# EasyEDA Pro project Access Control Core.eprj, schematic Card Reader (continued)
## Sheets (continued)
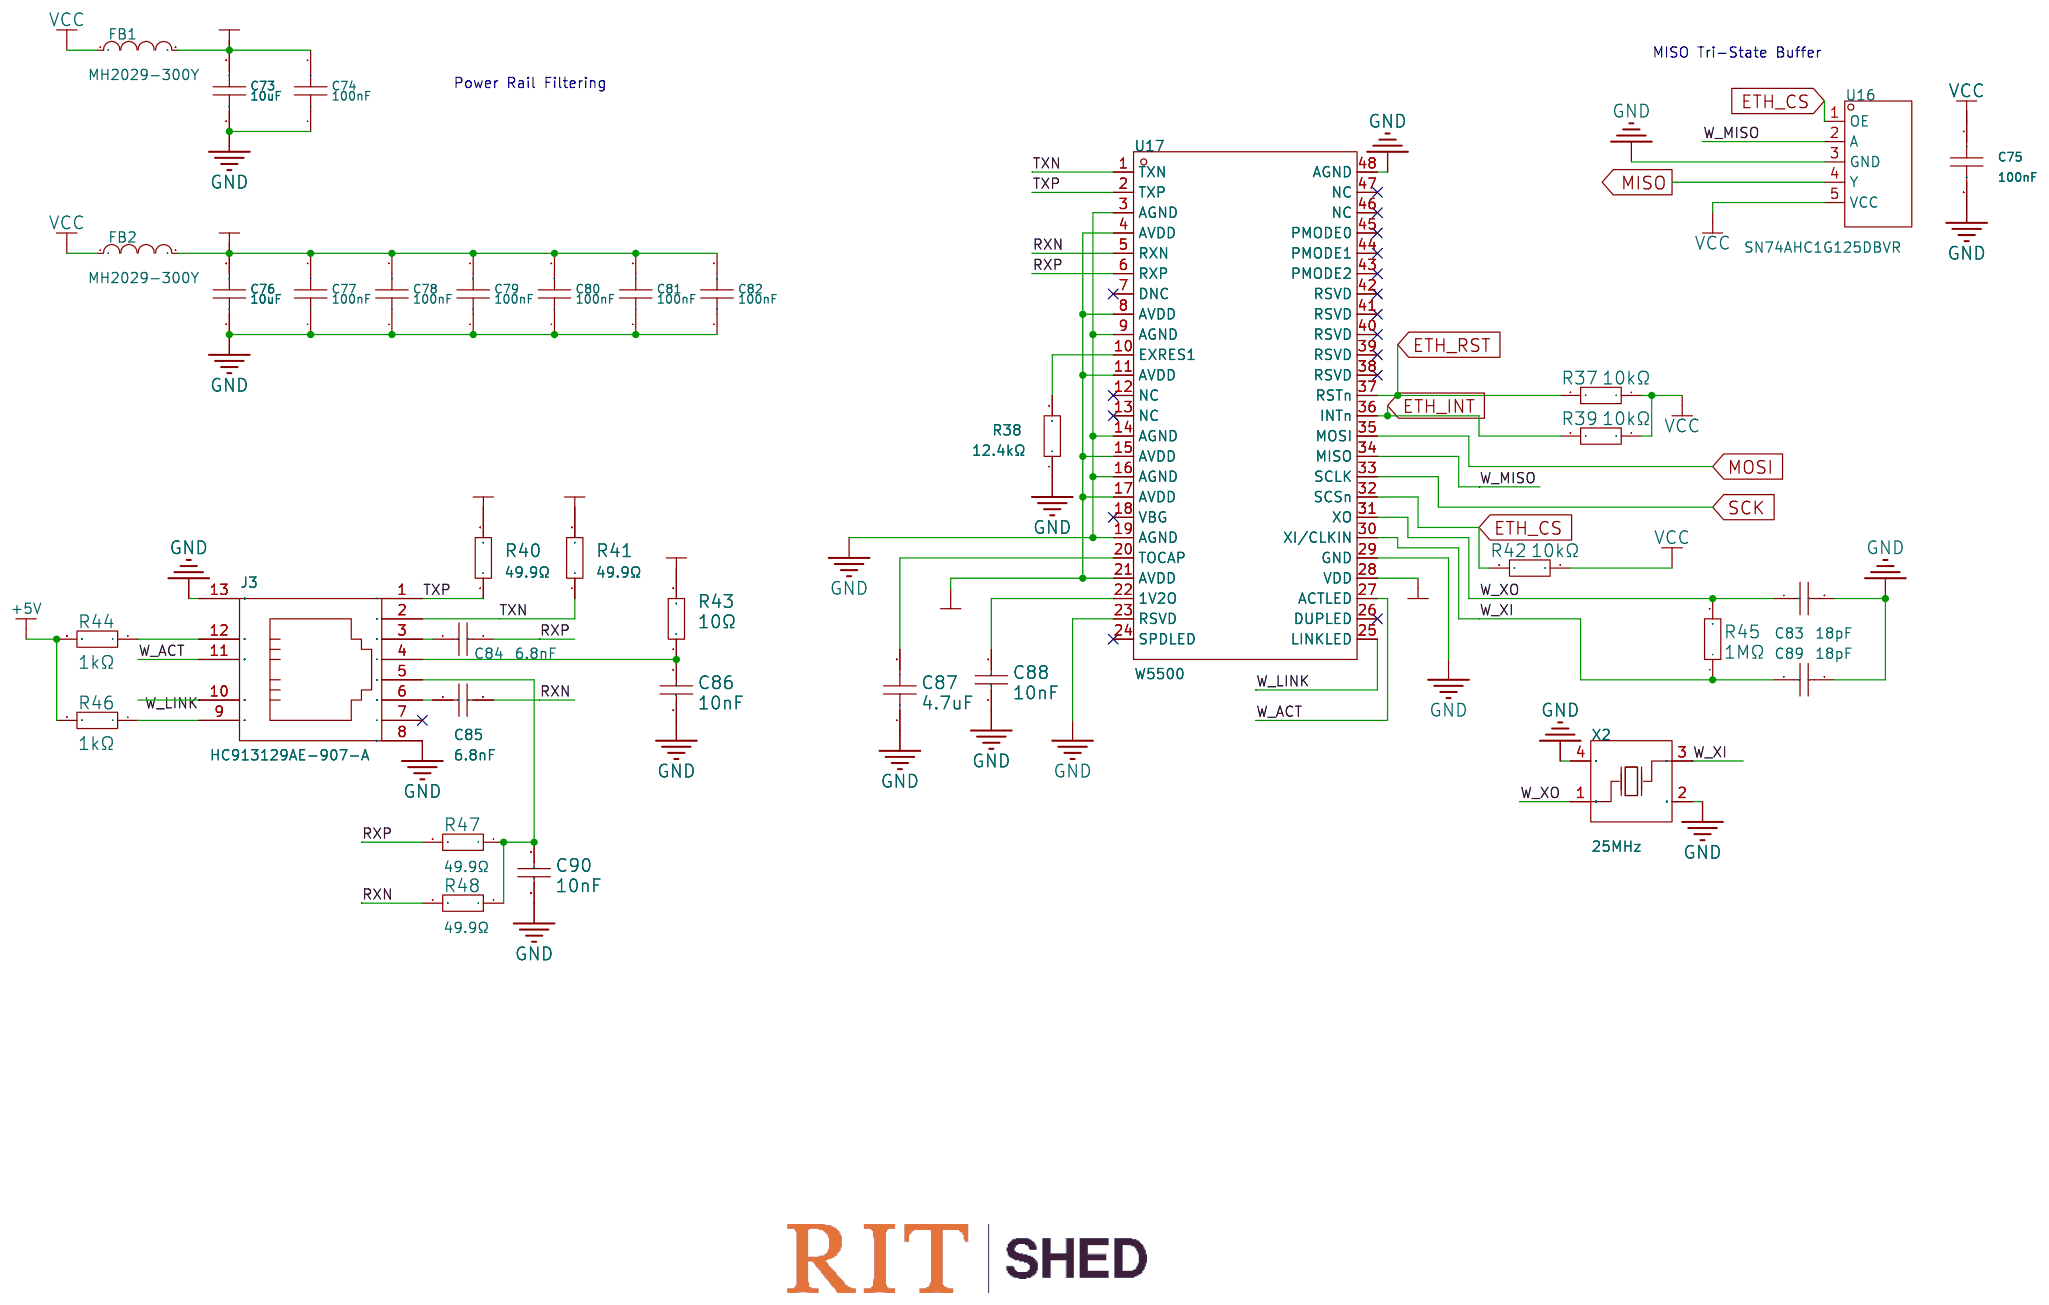
[diagram p4: Ethernet]
6 Microcontroller: Create Date: 2026-01-17; Page Name: Microcontroller; Update Date: 2026-01-21
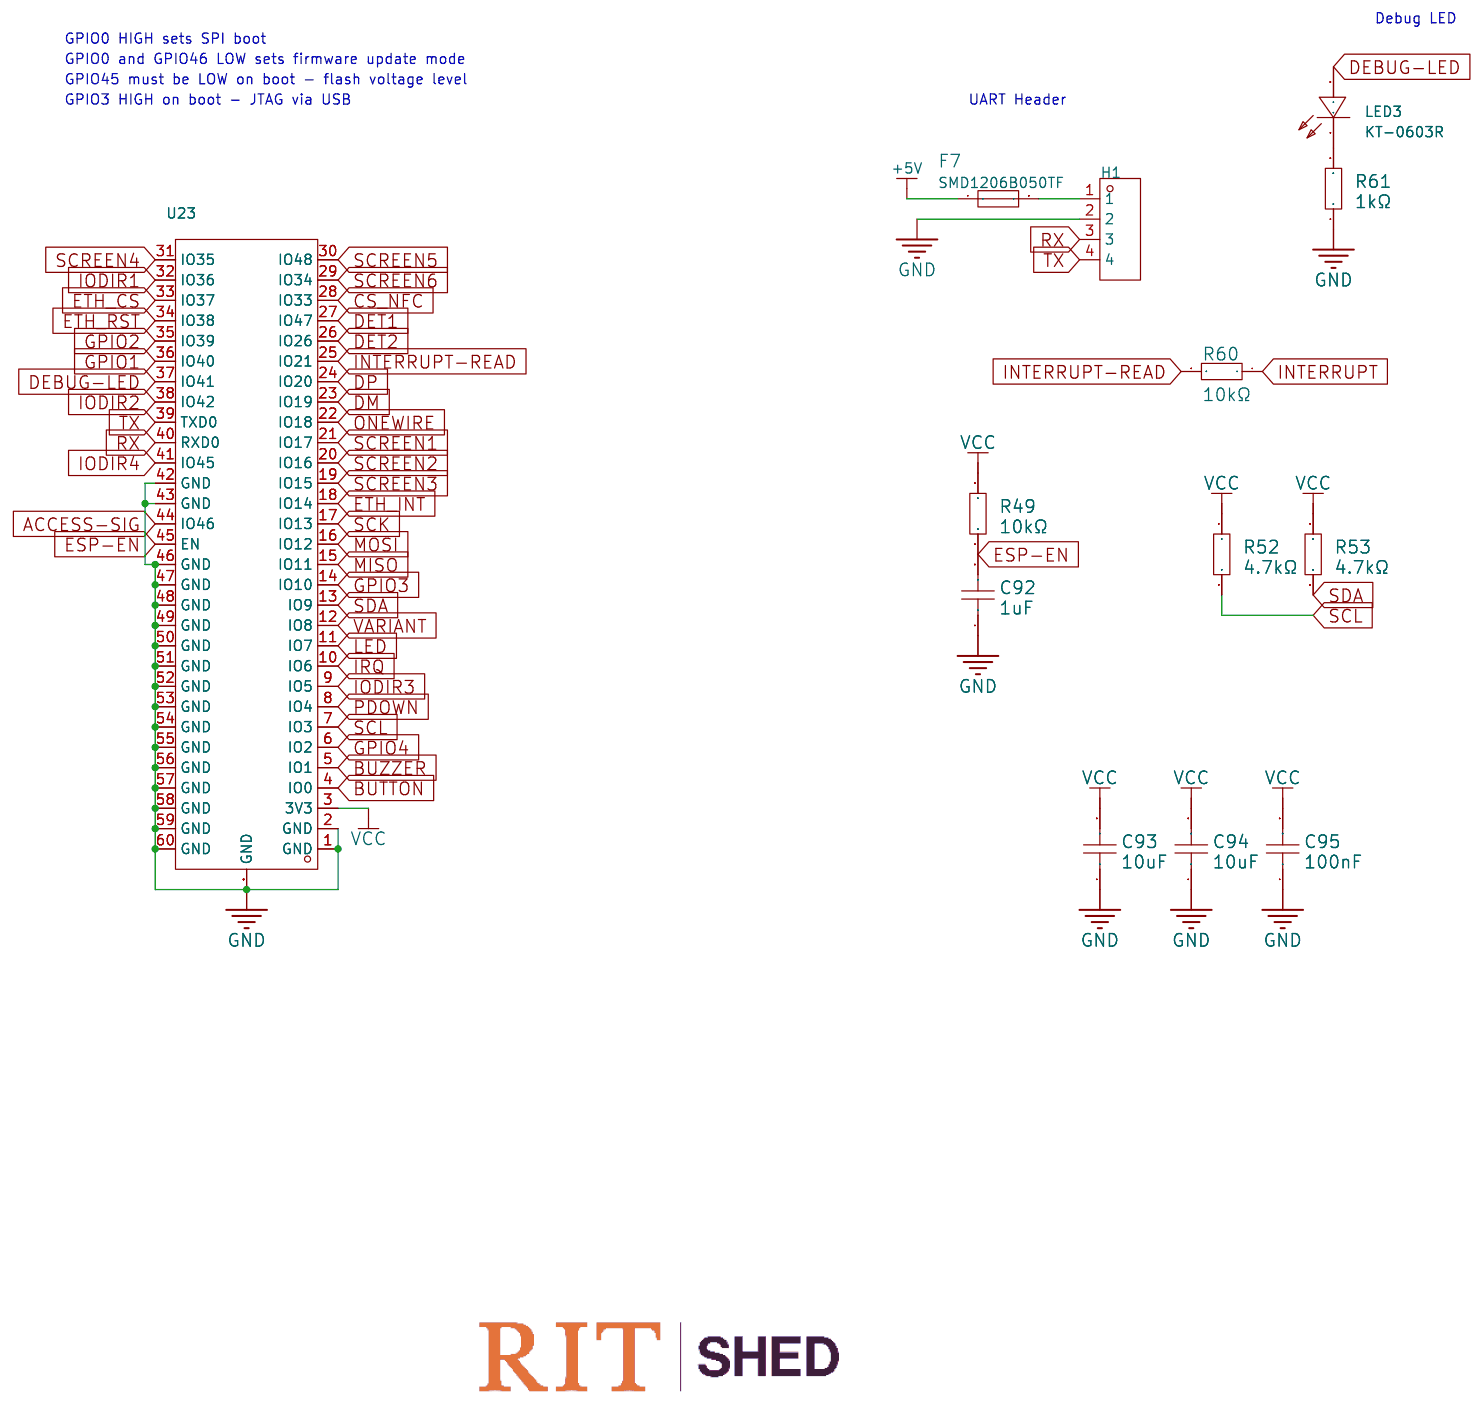
[diagram p5: Microcontroller]
7 Tap Variant: Create Date: 2026-01-18; Page Name: Tap Variant
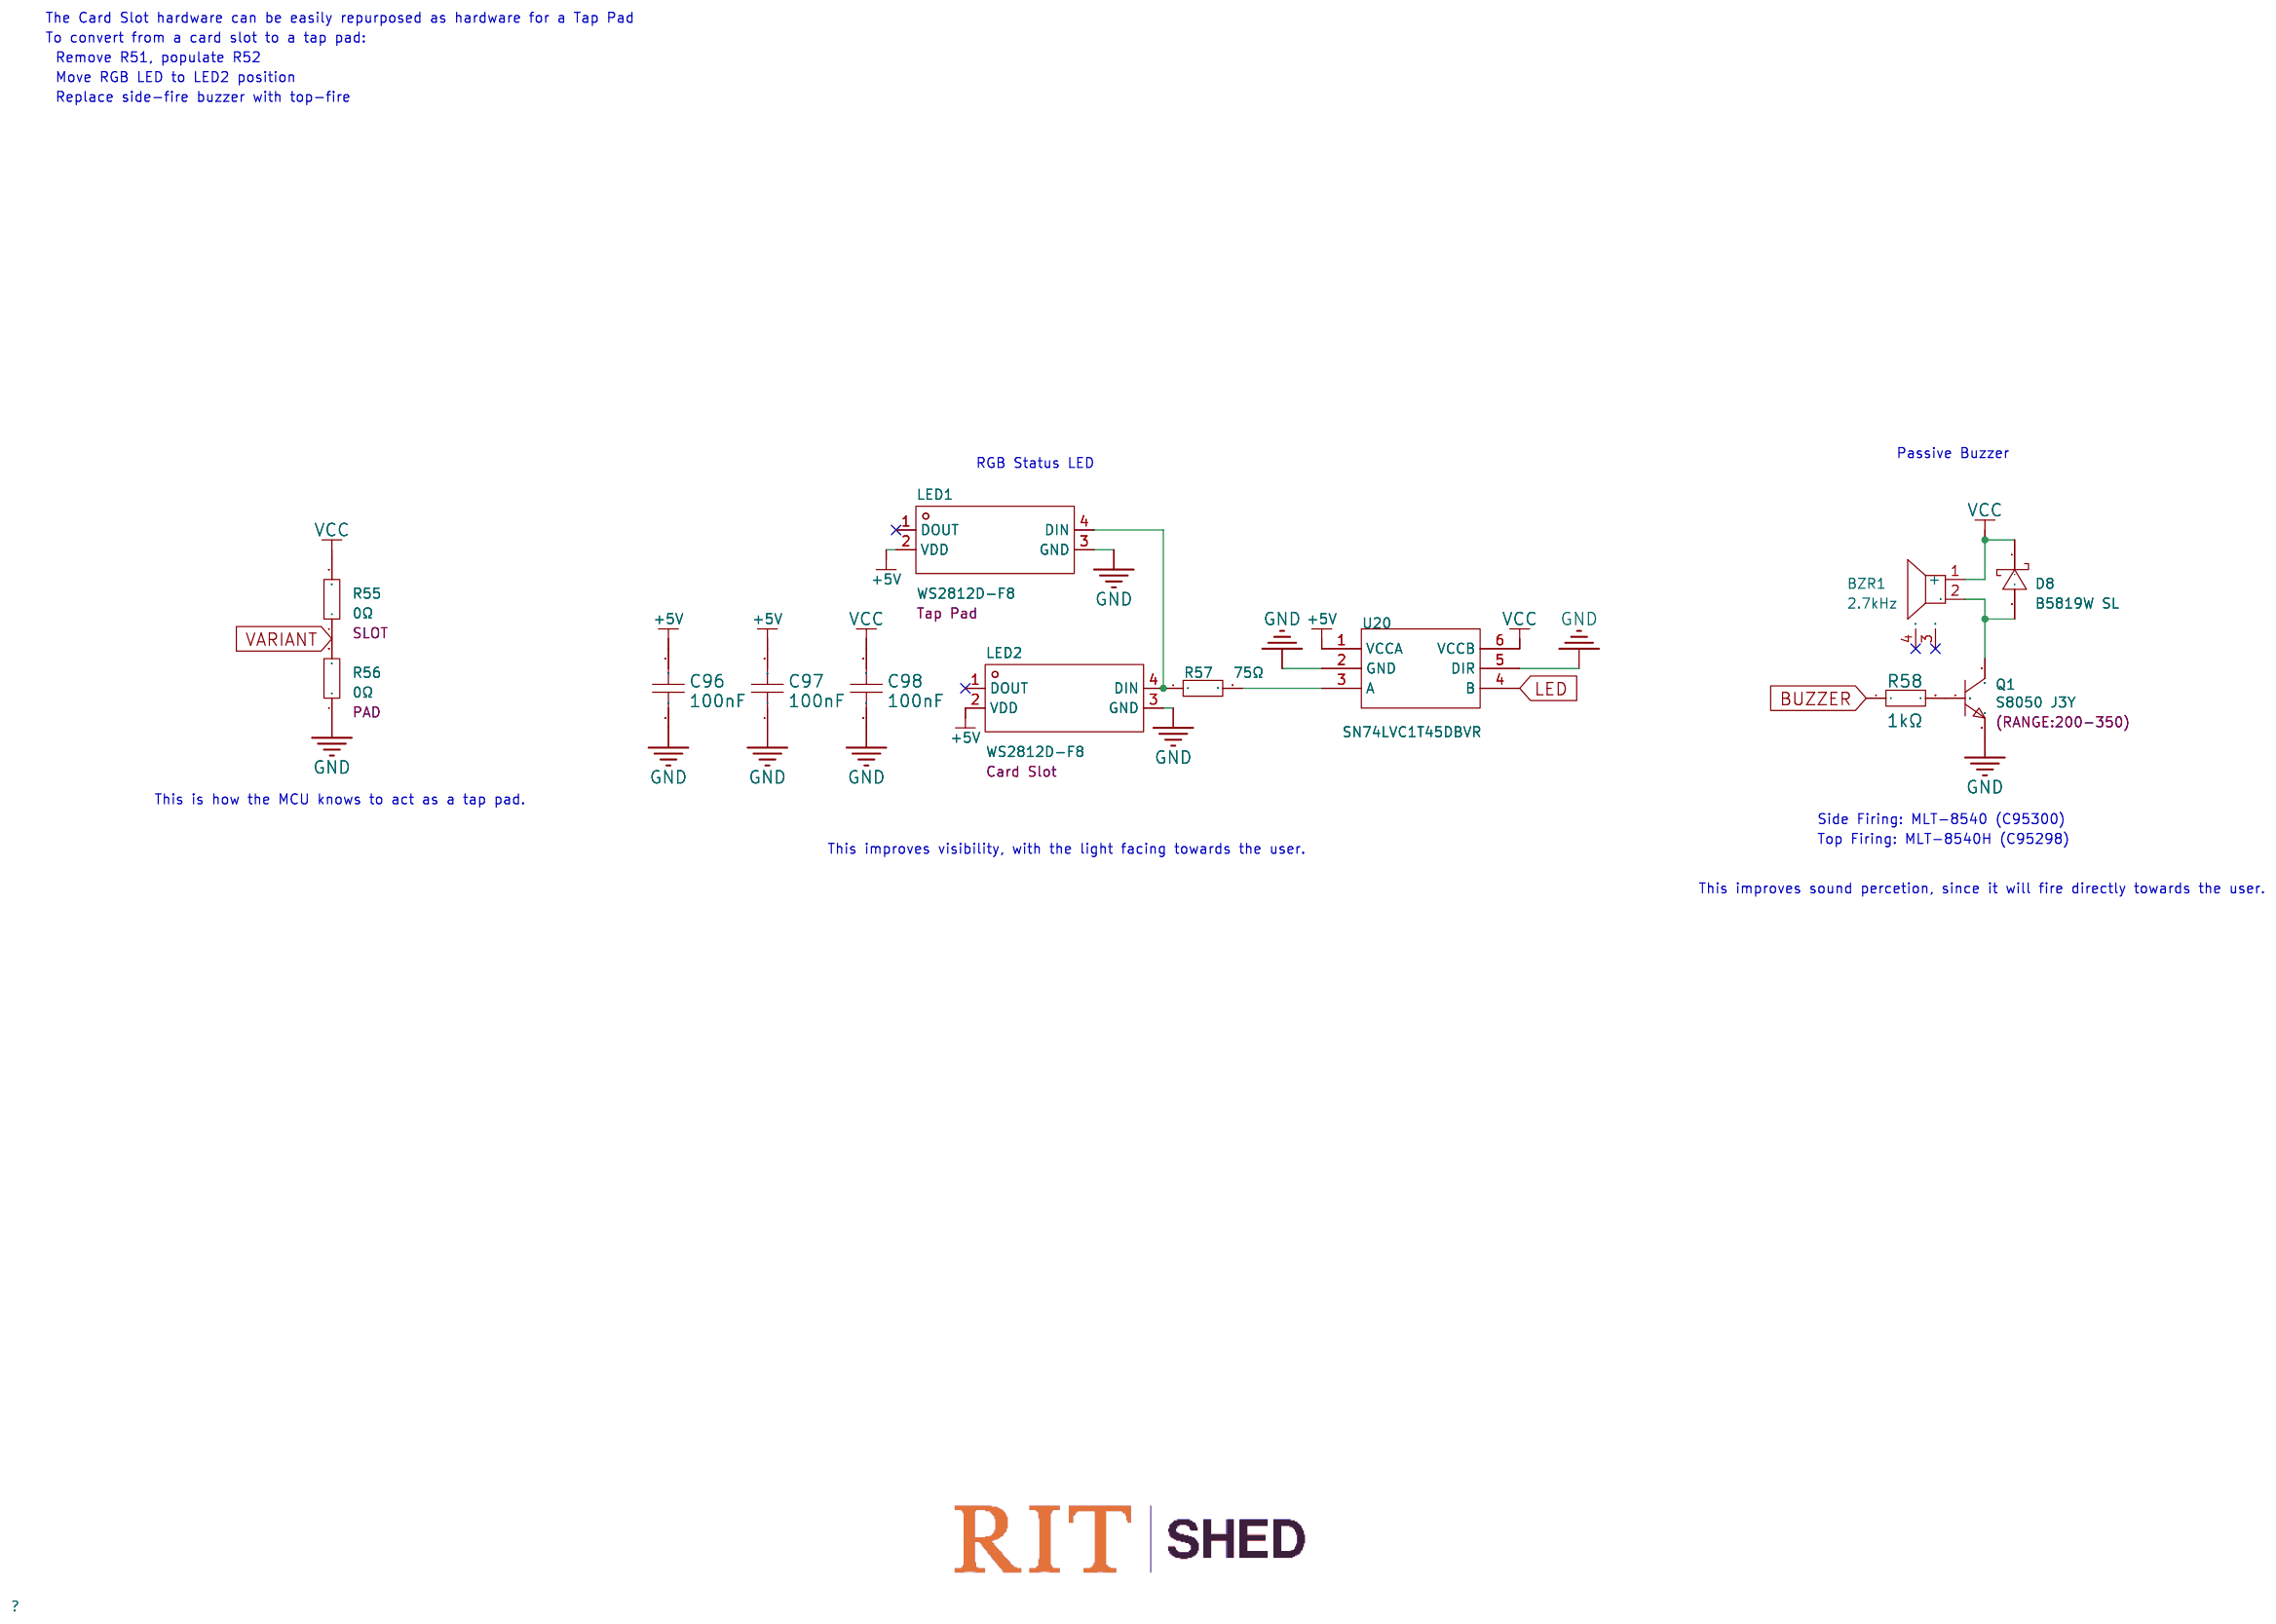
[diagram p6: Tap Variant]

## Parts
sheet Bus Connection
C32  100nF  [C0603]
C33  100nF  [C0603]
C34  100nF  [C0603]
C35  100nF  [C0603]
C36  100nF  [C0603]
C37  100nF  [C0603]
C38  10uF  [C0603]
C39  10uF  [C0603]
C40  100nF  [C0603]
C41  100nF  [C0603]
C42  47uF  [C1206]
C43  47uF  [C1206]
C44  100nF  [C0603]
C45  100nF  [C0603]
C46  10uF  [C0603]
C47  10uF  [C0603]
C48  10uF  [C0603]
C49  10uF  [C0603]
C50  10uF  [C0603]
D2  SMFJ12A  [SOD-123F_L2.8-W1.8-LS3.7-RD]
D3  PTVS3V3S1UR,115  [SOD-123_L2.8-W1.8-LS3.7-RD]
D4  PTVS3V3S1UR,115  [SOD-123_L2.8-W1.8-LS3.7-RD]
D5  SRV05-4  [SOT-23-6_L2.9-W1.6-P0.95-LS2.8-BL]
F3  JK-nSMD100-16  [F1206]
F4  JK-nSMD100-16  [F1206]
J2  DS1038-15FBNSiA74-0CC  [DSUB-TH_DS1038-15FBNSIA74-0CC]  (no BOM)
R16  4.7kΩ  [R0603]
R17  4.7kΩ  [R0603]
R18  4.7kΩ  [R0603]
R19  4.7kΩ  [R0603]
R20  10kΩ  [R0603]
R21  10kΩ  [R0603]
R22  10kΩ  [R0603]
R23  10kΩ  [R0603]
R24  4.7kΩ  [R0603]
R25  4.7kΩ  [R0603]
R26  10kΩ  [R0603]
R27  10kΩ  [R0603]
U8  SN74LVC1T45DBVR  [SOT-23-6_L2.9-W1.6-P0.95-LS2.8-BR]
U9  SN74LVC1T45DBVR  [SOT-23-6_L2.9-W1.6-P0.95-LS2.8-BR]
U10  SN74LVC1T45DBVR  [SOT-23-6_L2.9-W1.6-P0.95-LS2.8-BR]
U11  SN74LVC1T45DBVR  [SOT-23-6_L2.9-W1.6-P0.95-LS2.8-BR]
U12  SN74LVC1T45DBVR  [SOT-23-6_L2.9-W1.6-P0.95-LS2.8-BR]
sheet Ethernet
C73  10uF  [C0603]
C74  100nF  [C0603]
C75  100nF  [C0603]
C76  10uF  [C0603]
C77  100nF  [C0603]
C78  100nF  [C0603]
C79  100nF  [C0603]
C80  100nF  [C0603]
C81  100nF  [C0603]
C82  100nF  [C0603]
C83  18pF  [C0603]
C84  6.8nF  [C0603]
C85  6.8nF  [C0603]
C86  10nF  [C0603]
C87  4.7uF  [C0603]
C88  10nF  [C0603]
C89  18pF  [C0603]
C90  10nF  [C0603]
FB1  MH2029-300Y  [L0805]
FB2  MH2029-300Y  [L0805]
J3  HC913129AE-907-A  [RJ45-TH_HC911102A-904-A]  (no BOM)
R37  10kΩ  [R0603]
R38  12.4kΩ  [R0603]
R39  10kΩ  [R0603]
R40  49.9Ω  [R0603]
R41  49.9Ω  [R0603]
R42  10kΩ  [R0603]
R43  10Ω  [R0603]
R44  1kΩ  [R0603]
R45  1MΩ  [R0603]
R46  1kΩ  [R0603]
R47  49.9Ω  [R0603]
R48  49.9Ω  [R0603]
U16  SN74AHC1G125DBVR  [SOT-23-5_L3.0-W1.7-P0.95-LS2.8-BR]
U17  W5500  [LQFP-48_L7.0-W7.0-P0.50-LS9.0-BL]
X2  25MHz  [CRYSTAL-SMD_4P-L3.2-W2.5-BL]
sheet Interfaces
C21  47uF  [C1206]
C22  47uF  [C1206]
C23  100nF  [C0603]
C24  100nF  [C0603]
C25  10nF  [C0603]
C26  100nF  [C0603]
C27  100nF  [C0603]
C28  10uF  [C0603]
C101  10uF  [C0603]
C102  1uF  [C0603]
CN2  B-3002N14P-0110  [IDC-SMD_14P-P2.00_B-3002N14P-0110]
D1  SRV05-4  [SOT-23-6_L2.9-W1.6-P0.95-LS2.8-BL]
F1  SMD1206B050TF  [F1206]
F2  SMD1206B050TF  [F1206]
F5  SMD1206B050TF  [F1206]
J1  HC-GAP-ACF012-1T  [USB-C-SMD_HC-GAP-ACF012-1T-1]  (no BOM)
R11  100kΩ  [R0603]
R13  5.1kΩ  [R0603]
R14  5.1kΩ  [R0603]
R59  1kΩ  [R0603]
SW3  TS-1045-A13B3-D2  [SW-SMD_L7.5-W8.0-P4.50_TS-1045-A13B3-D2]
U4  SN74LVC1G17DBVR  [SOT-23-5_L3.0-W1.7-P0.95-LS2.8-BR]
U5  TMP112AIDRLR  [SOT-563_L1.6-W1.2-P0.50-LS1.6-BR]
U6  LIS2DH12TR  [LGA-12_L2.0-W2.0-P0.50-BL]
U22  MX66100T  [SOT-23-6_L2.9-W1.6-P0.95-LS2.9-BL]
sheet Microcontroller
C92  1uF  [C0603]
C93  10uF  [C0603]
C94  10uF  [C0603]
C95  100nF  [C0603]
F7  SMD1206B050TF  [F1206]
H1  -  [HDR-TH_4P-P2.54-V-M]
LED3  KT-0603R  [LED0603-RD]
R49  10kΩ  [R0603]
R52  4.7kΩ  [R0603]
R53  4.7kΩ  [R0603]
R60  10kΩ  [R0603]
R61  1kΩ  [R0603]
U23  2.4GHz  [BULETM-SMD_ESP32-S3-MINI-1-N8]
sheet NFC Reader
ANT1  -  [NFC Antenna Footprint]  (no BOM)
C1  12pF  [C0603]
C2  470nF  [C0603]
C3  100nF  [C0603]
C4  470nF  [C0603]
C5  1uF  [C0603]
C6  100nF  [C0603]
C7  12pF  [C0603]
C8  100nF  [C0603]
C9  1nF  [C0603]
C10  68pF  [C0603]
C11  120pF  [C0603]
C12  120pF  [C0603]
C13  100nF  [C0603]
C14  100nF  [C0603]
C15  100nF  [C0603]
C16  100nF  [C0603]
C17  120pF  [C0603]
C18  120pF  [C0603]
C19  68pF  [C0603]
C20  1nF  [C0603]
L1  470nH  [L0603]
L2  470nH  [L0603]
M1  SMTSO3060CTJ  [SMD_SMTSO3060CTJ]
M2  SMTSO3060CTJ  [SMD_SMTSO3060CTJ]
M3  SMTSO3060CTJ  [SMD_SMTSO3060CTJ]
M4  SMTSO3060CTJ  [SMD_SMTSO3060CTJ]
M5  SMTSO3060CTJ  [SMD_SMTSO3060CTJ]
R1  10kΩ  [R0603]
R2  10kΩ  [R0603]
R3  1kΩ  [R0603]
R4  22kΩ  [R0603]
R5  100kΩ  [R0603]
R6  100kΩ  [R0603]
R7  5.1Ω  [R0603]
R8  5.1Ω  [R0603]
R9  22kΩ  [R0603]
R10  1kΩ  [R0603]
SW1  K9-1267F  [SW-TH_K9-1267F]  (no BOM)
SW2  K9-1267F  [SW-TH_K9-1267F]  (no BOM)
U1  MFRC63003HNE  [HVQFN-32_L5.0-W5.0-P0.50-TL-EP3.1]
U2  SN74LVC1G17DBVR  [SOT-23-5_L3.0-W1.7-P0.95-LS2.8-BR]
U3  SN74LVC1G17DBVR  [SOT-23-5_L3.0-W1.7-P0.95-LS2.8-BR]
X1  27.12MHz  [CRYSTAL-SMD_4P-L3.2-W2.5-BL-1]
sheet Regulators
C51  30pF  [C0603]
C52  10uF  [C0603]
C53  10uF  [C0603]
C54  100nF  [C0603]
C55  10uF  [C0603]
C56  47uF  [C1206]
C57  10uF  [C0603]
C58  10uF  [C0603]
C59  33nF  [C0603]
C60  100nF  [C0603]
C63  10uF  [C0603]
C64  10uF  [C0603]
C65  100nF  [C0603]
C66  10uF  [C0603]
C67  10uF  [C0603]
C68  10uF  [C0603]
C69  10uF  [C0603]
C70  10uF  [C0603]
C71  33nF  [C0603]
C72  100nF  [C0603]
C99  10uF  [C0603]
C100  1uF  [C0603]
D6  B5819W SL  [SOD-123_L2.7-W1.6-LS3.7-RD-1]
D7  B5819W SL  [SOD-123_L2.7-W1.6-LS3.7-RD-1]
F6  JK-nSMD100-16  [F1206]
L3  4.7uH  [IND-SMD_L7.1-W6.6]
L4  4.7uH  [IND-SMD_L7.1-W6.6]
R28  10kΩ  [R0603]
R29  10kΩ  [R0603]
R30  22kΩ  [R0603]
R32  10kΩ  [R0603]
R33  1kΩ  [R0603]
R34  1kΩ  [R0603]
R35  51kΩ  [R0603]
R36  1kΩ  [R0603]
U13  TPS62933DRLR  [SOT-583-8_L2.1-W1.2-P0.50-LS1.6-BR]
U15  TPS62933DRLR  [SOT-583-8_L2.1-W1.2-P0.50-LS1.6-BR]
U21  MX66100T  [SOT-23-6_L2.9-W1.6-P0.95-LS2.9-BL]
sheet Tap Variant
BZR1  2.7kHz  [BUZ-SMD_4P-L8.5-W8.5-P8.50-TL]  (no BOM)
C96  100nF  [C0603]
C97  100nF  [C0603]
C98  100nF  [C0603]
D8  B5819W SL  [SOD-123_L2.7-W1.6-LS3.7-RD-1]
LED1  WS2812D-F8  [LED-TH_WS2812D-F8]  (no BOM)
LED2  WS2812D-F8  [LED-TH_WS2812D-F8]  (no BOM)
Q1  S8050 J3Y  [SOT-23-3_L3.0-W1.7-P0.95-LS2.9-BR]
R55  0Ω  [R0805]  (no BOM)
R56  0Ω  [R0805]  (no BOM)
R57  75Ω  [R0603]
R58  1kΩ  [R0603]
U20  SN74LVC1T45DBVR  [SOT-23-6_L2.9-W1.6-P0.95-LS2.8-BR]

## Library data of the parts
C3 C6 C8 C13-C16 C23 C24 C26 C27 C32-C37 C40 C41 C44 C45 C54 C60 C65 C72 C74 C75 C77-C82 C95-C98 = CC0603KRX7R9BB104: Capacitance: Tolerance:±10% Tolerance:±10% Voltage Rated: Temperature Coefficient:; LCSC Part Name: 100nF ±10% 50V; Supplier Part: C14663; Manufacturer: YAGEO(国巨); Supplier Footprint: 0603; JLCPCB Part Class: Basic Part; Datasheet: https://atta.szlcsc.com/upload/public/pdf/source/20180910/C282072_33301C7F631E79921B82A8DAC6BCC5B3.pdf; Supplier: LCSC; Tolerance: ±10%
C28 C38 C39 C46-C50 C52 C53 C55 C57 C58 C63 C64 C66-C70 C73 C76 C93 C94 C99 C101 = CL10A106MA8NRNC: LCSC Part Name: 10uF ±20% 25V; Supplier Part: C96446; Manufacturer: SAMSUNG(三星); Supplier Footprint: 0603; JLCPCB Part Class: Basic Part; Datasheet: https://item.szlcsc.com/datasheet/CL10A106MA8NRNC/97651.html; Supplier: LCSC; Tolerance: ±20%; Voltage Rating: 25V; Temperature Coefficient: X5R
C42 C43 = CL31A476MPHNNNE: LCSC Part Name: 47uF ±20% 10V; Supplier Part: C96123; Manufacturer: SAMSUNG(三星); Supplier Footprint: 1206; JLCPCB Part Class: Basic Part; Datasheet: https://item.szlcsc.com/datasheet/CL31A476MPHNNNE/97327.html; Supplier: LCSC; Tolerance: ±20%; Voltage Rating: 10V; Temperature Coefficient: X5R
D2 = SMFJ12A: LCSC Part Name: 单向TVS 12V截止 峰值浪涌电流：10A@10/1000us; Supplier Part: C82280; Manufacturer: RUILON(瑞隆源); Supplier Footprint: SOD-123; Datasheet: https://item.szlcsc.com/datasheet/SMFJ12A/83437.html; Supplier: LCSC; Polarity: Unidirectional; Reverse Stand-Off Voltage (Vrwm): 12V; Clamping Voltage: 19.9V; Peak Pulse Current (Ipp): 10A@10/1000us; Peak Pulse Power Dissipation (Ppp): 200W@10/1000us; Voltage - Breakdown: 14.7V; Reverse Leakage Current (Ir): 1uA; Operating Temperature: -55℃~+150℃; Type: TVS
D3 D4 = PTVS3V3S1UR,115: Supplier Part: C183521; Manufacturer: Nexperia(安世); Supplier Footprint: SOD-123W; Datasheet: https://item.szlcsc.com/datasheet/PTVS3V3S1UR%252C115/194925.html; Supplier: LCSC; Polarity: Unidirectional; Reverse Stand-Off Voltage (Vrwm): 3.3V; Clamping Voltage: 8V; Peak Pulse Current (Ipp): 43.8A@10/1000us; Peak Pulse Power Dissipation (Ppp): 350W@10/1000us; Voltage - Breakdown: 5.6V; Reverse Leakage Current (Ir): 5uA; level of protection: IEC 61000-4-2; Type: TVS
D1 D5 = SRV05-4_C558418: polarity:Unidirectional Reverse Stand-Off Voltage (Vrwm):5V Maximum Clamping Voltage:20V Peak Pulse Current (Ipp):3A Peak Pulse Power Dissipation (Ppp):60W Breakdown Voltage:6V Reverse Leakage Current (Ir):500nA Number of Lines:Four channels Operating Tem; LCSC Part Name: ESD，可防25kV静电; Supplier Part: C558418; Manufacturer: TECH PUBLIC(台舟); Supplier Footprint: SOT-23-6; JLCPCB Part Class: Extended Part; Datasheet: https://atta.szlcsc.com/upload/public/pdf/source/20230615/CFFDFFE99FDA0E92DF9600783B3A2A20.pdf; Supplier: LCSC; polarity: Unidirectional; Reverse Stand-Off Voltage (Vrwm): 5V; Maximum Clamping Voltage: 20V; Peak Pulse Current (Ipp): 3A; Peak Pulse Power Dissipation (Ppp): 60W; Breakdown Voltage: 6V; Reverse Leakage Current (Ir): 500nA; Number of Lines: Four channels; Operating Temperature: -55℃~+125℃; level of protection: IEC 61000-4-2; Type: ESD
F3 F4 F6 = JK-nSMD100-16_C369161: LCSC Part Name: 16V 1A 1206自恢复; Supplier Part: C369161; Manufacturer: JK(金科); Supplier Footprint: 1206; Datasheet: https://item.szlcsc.com/datasheet/JK-nSMD100-16/343074.html; Supplier: LCSC; Voltage - Max: 16V; Current - Max: 100A; Hold Current: 1A; Trip Current: 1.8A; Resistance - Initial (Ri) (Min): 55mΩ; Resistance - Post Trip (R1) (Max): 330mΩ; Time to Trip(Max): 300ms; Operating Temperature: -40℃~+85℃; Length: 3.5mm; Width: 1.8mm; Height: 1.3mm
J2 = DS1038-15FBNSiA74-0CC: LCSC Part Name: 黑色 1000/盒 D-Sub 母 P数:15P; Supplier Part: C75754; Manufacturer: CONNFLY; Supplier Footprint: 弯插; JLCPCB Part Class: Extended Part; Datasheet: https://item.szlcsc.com/datasheet/DS1038-15FBNSiA74-0CC/76880.html; Supplier: LCSC; Connector Type: High Density D-Sub; Gender: Female; Number of Pins: 15P; Mounting Type: Right Angle; Number of Rows: 3; Current Rating-Signal: 3A; Color: Black; Operating Temperature: -40℃~+105℃
R16-R19 R24 R25 R52 R53 = 0603WAF4701T5E: Type:Thick Film Resistors Resistance:4.7kΩ Tolerance:±1% Tolerance:±1% Power(Watts): Overload Voltage (Max): Temperature Coefficient:±100ppm/℃ Temperature Coefficient:±100ppm/℃ Operating Temperature Range:-55℃~+155℃ Operating Temperature Range:-55℃~+155℃; LCSC Part Name: 4.7kΩ ±1% 100mW 厚膜电阻; Supplier Part: C23162; Manufacturer: UNI-ROYAL(厚声); Supplier Footprint: 0603; JLCPCB Part Class: Basic Part; Datasheet: https://atta.szlcsc.com/upload/public/pdf/source/20200306/C422600_1E6D84923E4A46A82E41ADD87F860B5C.pdf; Supplier: LCSC; Type: Thick Film Resistors; Tolerance: ±1%; Temperature Coefficient: ±100ppm/℃; Operating Temperature Range: -55℃~+155℃
R1 R2 R20-R23 R26-R29 R32 R37 R39 R42 R49 R60 = 0603WAF1002T5E: Type:Thick Film Resistors Resistance:10kΩ Tolerance:±1% Tolerance:±1% Power(Watts): Overload Voltage (Max): Temperature Coefficient:±100ppm/℃ Temperature Coefficient:±100ppm/℃ Operating Temperature Range:-55℃~+155℃ Operating Temperature Range:-55℃~+155℃; LCSC Part Name: 厚膜电阻 10kΩ ±1% 100mW; Supplier Part: C25804; Manufacturer: UNI-ROYAL(厚声); Supplier Footprint: 0603; JLCPCB Part Class: Basic Part; Datasheet: https://atta.szlcsc.com/upload/public/pdf/source/20200306/C422600_1E6D84923E4A46A82E41ADD87F860B5C.pdf; Supplier: LCSC; Type: Thick Film Resistors; Tolerance: ±1%; Temperature Coefficient: ±100ppm/℃; Operating Temperature Range: -55℃~+155℃
U8-U12 U20 = SN74LVC1T45DBVR: Supplier Part: C7843; Manufacturer: TI(德州仪器); Supplier Footprint: SOT-23-6; Datasheet: https://www.ti.com/cn/lit/gpn/sn74lvc1t45; Supplier: LCSC; Channel Type: Bidirectional; Data Rate: 420Mbps; Voltage - Supply(VCCA): 1.65V~5.5V; Voltage - Supply(VCCB): 1.65V~5.5V; Number of Circuits: 1; Output Type: Tri-State; Operating Temperature: -40℃~+85℃
C83 C89 = CL10C180JB8NNNC: Capacitance: Tolerance:±5% Tolerance:±5% Voltage Rated: Temperature Coefficient:; LCSC Part Name: 18pF ±5% 50V; Supplier Part: C1647; Manufacturer: SAMSUNG(三星); Supplier Footprint: 0603; JLCPCB Part Class: Basic Part; Datasheet: https://atta.szlcsc.com/upload/public/pdf/source/20160218/1457707763339.pdf; Supplier: LCSC; Tolerance: ±5%
C84 C85 = 0603B682K500NT: LCSC Part Name: 6.8nF ±10% 50V; Supplier Part: C1631; Manufacturer: FH(风华); Supplier Footprint: 0603; JLCPCB Part Class: Basic Part; Datasheet: https://item.szlcsc.com/datasheet/0603B682K500NT/1983.html; Supplier: LCSC; Tolerance: ±10%; Voltage Rating: 50V; Temperature Coefficient: X7R
C25 C86 C88 C90 = 0603B103K500NT: Capacitance:10nF Tolerance:±10% Tolerance:±10% Voltage Rated: Temperature Coefficient:; LCSC Part Name: 10nF ±10% 50V; Supplier Part: C57112; Manufacturer: FH(风华); Supplier Footprint: 0603; JLCPCB Part Class: Basic Part; Datasheet: https://atta.szlcsc.com/upload/public/pdf/source/20200305/C486355_26A10D38EF8C2A5C37091D0039909270.pdf; Supplier: LCSC; Tolerance: ±10%
C87 = CL10A475KO8NNNC: Capacitance: Tolerance:±10% Tolerance:±10% Voltage Rated: Temperature Coefficient:; LCSC Part Name: 4.7uF ±10% 16V; Supplier Part: C19666; Manufacturer: SAMSUNG(三星); Supplier Footprint: 0603; JLCPCB Part Class: Basic Part; Datasheet: https://atta.szlcsc.com/upload/public/pdf/source/20160218/1457707763339.pdf; Supplier: LCSC; Tolerance: ±10%
FB1 FB2 = MH2029-300Y: Impedance @ Frequency:30Ω@100MHz Tolerance:±25% Tolerance:±25% DC Resistance:25mΩ Current Rating:3A Circuits:1; LCSC Part Name: 单路 0805磁珠 阻抗30Ω@100MHz; Supplier Part: C840593; Manufacturer: BOURNS; Supplier Footprint: 0805; JLCPCB Part Class: Extended Part; Datasheet: https://atta.szlcsc.com/upload/public/pdf/source/20200907/C780182_6AA2A849D07FE675FBDEC0D82719ED6E.pdf; Supplier: LCSC; Impedance @ Frequency: 30Ω@100MHz; Tolerance: ±25%; DC Resistance: 25mΩ; Current Rating: 3A; Circuits: 1
J3 = HC913129AE-907-A: Connector Type:RJ45Receptacle Number of Ports:1 Mounting Style:Right-Angle Shielding:有屏蔽 LED:WithLED Contact Material:Phosphor bronze Contact Plating:Gold Operating Temperature Range:-40℃~+85℃ Operating Temperature Range:-40℃~+85℃ Soldering Temperature(Ma; LCSC Part Name: 弯插 带LED; Supplier Part: C5341218; Manufacturer: HCTL(华灿天禄); Supplier Footprint: 插件; JLCPCB Part Class: Extended Part; Datasheet: https://atta.szlcsc.com/upload/public/pdf/source/20230620/1EF30919FD4FC73383A5674A58476AE5.pdf; Supplier: LCSC; Connector Type: RJ45Receptacle; Number of Ports: 1; Mounting Style: Right-Angle; Shielding: 有屏蔽; LED: WithLED; Contact Material: Phosphor bronze; Contact Plating: Gold; Operating Temperature Range: -40℃~+85℃; Soldering Temperature(Max): 260℃@5S